# EasyEDA Pro project 24-Dart-Controller.eprj (continued)
## Library data of the parts (continued)
R10 R12 = 0402WGF5101TCE: 电阻类型:厚膜电阻;阻值:5.1kΩ;精度:±1%;功率:62.5mW;最大工作电压:50V;温度系数:±100ppm/℃;; LCSC Part Name: 5.1kΩ ±1% 62.5mW 厚膜电阻; Supplier Part: C25905; Manufacturer: UNI-ROYAL(厚声); Supplier Footprint: 0402; JLCPCB Part Class: 基础库; Datasheet: https://atta.szlcsc.com/upload/public/pdf/source/20200306/C422600_1E6D84923E4A46A82E41ADD87F860B5C.pdf; Supplier: LCSC; Type: 厚膜电阻; Tolerance: ±1%; Power(Watts): 62.5mW; Overload Voltage (Max): 50V; Temperature Coefficient: ±100ppm/℃; Operating Temperature Range: -55℃~+155℃
R13 = 0402WGF1003TCE: 电阻类型:厚膜电阻;阻值:100kΩ;精度:±1%;功率:62.5mW;最大工作电压:50V;温度系数:±100ppm/℃;; LCSC Part Name: 100kΩ ±1% 62.5mW 厚膜电阻; Supplier Part: C25741; Manufacturer: UNI-ROYAL(厚声); Supplier Footprint: 0402; JLCPCB Part Class: Basic Part; Datasheet: https://atta.szlcsc.com/upload/public/pdf/source/20200306/C422600_1E6D84923E4A46A82E41ADD87F860B5C.pdf; Supplier: LCSC; Type: 厚膜电阻; Tolerance: ±1%; Power(Watts): 62.5mW; Overload Voltage (Max): 50V; Temperature Coefficient: ±100ppm/℃; Operating Temperature Range: -55℃~+155℃
R14 = 0402WGF2200TCE: 电阻类型:厚膜电阻;阻值:220Ω;精度:±1%;功率:62.5mW;最大工作电压:50V;温度系数:±100ppm/℃;; LCSC Part Name: 220Ω ±1% 62.5mW 厚膜电阻; Supplier Part: C25091; Manufacturer: UNI-ROYAL(厚声); Supplier Footprint: 0402; JLCPCB Part Class: Basic Part; Datasheet: https://atta.szlcsc.com/upload/public/pdf/source/20200306/C422600_1E6D84923E4A46A82E41ADD87F860B5C.pdf; Supplier: LCSC; Type: 厚膜电阻; Tolerance: ±1%; Power(Watts): 62.5mW; Overload Voltage (Max): 50V; Temperature Coefficient: ±100ppm/℃; Operating Temperature Range: -55℃~+155℃
R15 = 0402WGF0000TCE: 电阻类型:厚膜电阻;阻值:0Ω;精度:±1%;功率:62.5mW;最大工作电压:50V;温度系数:±800ppm/℃;; LCSC Part Name: 0Ω ±1% 62.5mW 厚膜电阻; Supplier Part: C17168; Manufacturer: UNI-ROYAL(厚声); Supplier Footprint: 0402; JLCPCB Part Class: 基础库; Datasheet: https://atta.szlcsc.com/upload/public/pdf/source/20200306/C422600_1E6D84923E4A46A82E41ADD87F860B5C.pdf; Supplier: LCSC; Type: 厚膜电阻; Tolerance: ±1%; Power(Watts): 62.5mW; Overload Voltage (Max): 50V; Temperature Coefficient: ±800ppm/℃; Operating Temperature Range: -55℃~+155℃
R16 = 0603WAF200KT5E: 电阻类型:厚膜电阻;阻值:2Ω;精度:±1%;功率:100mW;最大工作电压:75V;温度系数:±200ppm/℃;; LCSC Part Name: 2Ω ±1% 100mW 厚膜电阻; Supplier Part: C22977; Manufacturer: UNI-ROYAL(厚声); Supplier Footprint: 0603; JLCPCB Part Class: 基础库; Datasheet: https://atta.szlcsc.com/upload/public/pdf/source/20200306/C422600_1E6D84923E4A46A82E41ADD87F860B5C.pdf; Supplier: LCSC; Type: 厚膜电阻; Tolerance: ±1%; Power(Watts): 100mW; Overload Voltage (Max): 75V; Temperature Coefficient: ±200ppm/℃; Operating Temperature Range: -55℃~+155℃
R17 R18 = 0603WAF100KT5E: 电阻类型:厚膜电阻;阻值:1Ω;精度:±1%;功率:100mW;最大工作电压:75V;温度系数:±400ppm/℃;; LCSC Part Name: 1Ω ±1% 100mW 厚膜电阻; Supplier Part: C22936; Manufacturer: UNI-ROYAL(厚声); Supplier Footprint: 0603; JLCPCB Part Class: Basic Part; Datasheet: https://atta.szlcsc.com/upload/public/pdf/source/20200306/C422600_1E6D84923E4A46A82E41ADD87F860B5C.pdf; Supplier: LCSC; Type: 厚膜电阻; Tolerance: ±1%; Power(Watts): 100mW; Overload Voltage (Max): 75V; Temperature Coefficient: ±400ppm/℃; Operating Temperature Range: -55℃~+155℃
R19 = 0402WGF2002TCE: 电阻类型:厚膜电阻;阻值:20kΩ;精度:±1%;功率:62.5mW;最大工作电压:50V;温度系数:±100ppm/℃;; LCSC Part Name: 20kΩ ±1% 62.5mW 厚膜电阻; Supplier Part: C25765; Manufacturer: UNI-ROYAL(厚声); Supplier Footprint: 0402; JLCPCB Part Class: 基础库; Datasheet: https://atta.szlcsc.com/upload/public/pdf/source/20200306/C422600_1E6D84923E4A46A82E41ADD87F860B5C.pdf; Supplier: LCSC; Type: 厚膜电阻; Tolerance: ±1%; Power(Watts): 62.5mW; Overload Voltage (Max): 50V; Temperature Coefficient: ±100ppm/℃; Operating Temperature Range: -55℃~+155℃
R20 = 0402WGF3302TCE: 电阻类型:厚膜电阻;阻值:33kΩ;精度:±1%;功率:62.5mW;最大工作电压:50V;温度系数:±100ppm/℃;; LCSC Part Name: 33kΩ ±1% 62.5mW 厚膜电阻; Supplier Part: C25779; Manufacturer: UNI-ROYAL(厚声); Supplier Footprint: 0402; JLCPCB Part Class: 基础库; Datasheet: https://atta.szlcsc.com/upload/public/pdf/source/20200306/C422600_1E6D84923E4A46A82E41ADD87F860B5C.pdf; Supplier: LCSC; Type: 厚膜电阻; Tolerance: ±1%; Power(Watts): 62.5mW; Overload Voltage (Max): 50V; Temperature Coefficient: ±100ppm/℃; Operating Temperature Range: -55℃~+155℃
R21 = 0603WAF2402T5E: 电阻类型:厚膜电阻;阻值:24kΩ;精度:±1%;功率:100mW;最大工作电压:75V;温度系数:±100ppm/℃;; LCSC Part Name: 24kΩ ±1% 100mW 厚膜电阻; Supplier Part: C23352; Manufacturer: UNI-ROYAL(厚声); Supplier Footprint: 0603; JLCPCB Part Class: 基础库; Datasheet: https://atta.szlcsc.com/upload/public/pdf/source/20200306/C422600_1E6D84923E4A46A82E41ADD87F860B5C.pdf; Supplier: LCSC; Type: 厚膜电阻; Tolerance: ±1%; Power(Watts): 100mW; Overload Voltage (Max): 75V; Temperature Coefficient: ±100ppm/℃; Operating Temperature Range: -55℃~+155℃
R22 = RC0402FR-0710KL: 电阻类型:厚膜电阻;阻值:10kΩ;精度:±1%;功率:62.5mW;最大工作电压:50V;温度系数:±100ppm/℃;; LCSC Part Name: 厚膜电阻 10kΩ ±1% 62.5mW; Supplier Part: C60490; Manufacturer: YAGEO(国巨); Supplier Footprint: 0402; JLCPCB Part Class: 扩展库; Datasheet: https://atta.szlcsc.com/upload/public/pdf/source/20170925/C131467_1506321478108990263.pdf; Supplier: LCSC; Type: 厚膜电阻; Tolerance: ±1%; Power(Watts): 62.5mW; Overload Voltage (Max): 50V; Temperature Coefficient: ±100ppm/℃; Operating Temperature Range: -55℃~+155℃
RX TX = Test-Point: Test Point 测试点; Check: false
SW1 SW2 = TS24CA: 电路结构:单刀单掷;按钮形状:矩形按钮;安装方式:卧贴;开关长度:4.55mm;开关宽度:1.8mm;开关高度:3.5mm;触点电流:50mA;额定电压(DC):12V;带灯:-;机械寿命:-;; LCSC Part Name: 4.55*1.8*3.5mm 卧贴 轻触开关; Supplier Part: C393942; Manufacturer: SHOU HAN(首韩); Supplier Footprint: SMD; JLCPCB Part Class: 扩展库; Datasheet: https://atta.szlcsc.com/upload/public/pdf/source/20190521/C393942_591A9E318887EFA4274D34029981AD99.pdf; Supplier: LCSC; Circuit: 单刀单掷; Actuator Style: 矩形按钮; Mounting Style: 卧贴; Switch Length: 4.55mm; Switch Width: 1.8mm; Switch Height: 3.5mm; Contact Current: 50mA; Voltage Rating (DC): 12V
U1 = ESP32-C3-MINI-1: 核心处理器:ESP32-C3芯片;频率:2.402GHz;天线形式:板载PCB天线;发射功率:-98dBm;接收灵敏度:-89dBm;; LCSC Part Name: 乐鑫ESP32 WiFi模块; Supplier Part: C5290152; Manufacturer: RF Crazy(智汉); JLCPCB Part Class: 扩展库; Datasheet: https://atta.szlcsc.com/upload/public/pdf/source/20230407/37C637B0DDC12E28939EC2C137730224.pdf; Supplier: LCSC; Core Processor: ESP32-C3芯片; Support Interface: UART; Antenna Type: 板载PCB天线; Output Power: -98dBm; Operating Voltage: 3V~3.6V; Receive  Current: 82mA; Send  Current: 350mA; Sensitivity: -89dBm; Operating Temperature: -40℃~+81℃
U3 = NU1680: Supplier Part: C9900015597; Supplier Footprint: QFN-16; JLCPCB Part Class: 扩展库; Datasheet: https://atta.szlcsc.comnull; Supplier: LCSC
U4 = IP5306-I2C: 2.1A 充电 2.4 A 放电高集成度移动电源 SOC; Supplier Part: C488349; Manufacturer: INJOINIC(英集芯); Supplier Footprint: ESOP-8; JLCPCB Part Class: 扩展库; Datasheet: https://atta.szlcsc.com/upload/public/pdf/source/20231017/AB6A25E64E1038420E9A7039637542A8.pdf; Supplier: LCSC
USB1 = MicroXNJ: 连接器类型:Micro-B;标准:USB 2.0;公母:母;端口数量:1;触点数量:5P;安装方式:卧贴;额定电流 - 电源:1A;工作温度范围:-20℃~+85℃;; LCSC Part Name: Micro-B 母 卧贴; Supplier Part: C404969; Manufacturer: SHOU HAN(首韩); Supplier Footprint: SMD; JLCPCB Part Class: 扩展库; Datasheet: https://atta.szlcsc.com/upload/public/pdf/source/20220415/2494EDFF499AF6F852F7C820374B6AF3.pdf; Supplier: LCSC; Connector Type: Micro-B; Standard: USB 2.0; Gender: 母; Number of Ports: 1; Number of Contacts: 5P; Mounting Style: 卧贴; Current Rating - Power (Max): 1A; Operating Temperature Range: -20℃~+85℃

## Nets
GND: C1.2 C2.1 C3.1 C4.1 C5.1 C6.1 C7.1 C8.1 C9.1 C10.2 C11.2 C18.1 C19.1 C20.2 C21.1 C22.1 C23.1 C24.1 C25.1 C26.1 C27.2 CN1.2 CN1.3 CN1.4 D2.2(A) LDO1.2(VSS) R6.1 R7.1 R11.2 R13.1 R15.1 R20.1 R22.2 SW1.1 SW1.2 SW1.4 SW2.1 SW2.2 SW2.4 U1.1(GND) U1.2(GND) U1.11(GND) U1.14(GND) U1.36(GND) U1.37(GND) U1.38(GND) U1.39(GND) U1.40(GND) U1.41(GND) U1.42(GND) U1.43(GND) U1.44(GND) U1.45(GND) U1.46(GND) U1.47(GND) U1.48(GND) U1.49(GND) U1.50(GND) U1.51(GND) U1.52(GND) U1.53(GND) U3.1(GND) U3.4(GND) U3.17(EP) U4.9(EP) USB1.5(GND) USB1.6(SH1) USB1.7(SH2) USB1.8(SH3) USB1.9(SH4)
VBAT: F1.1
VCC_3V3: C2.2 C4.2 C5.2 LDO1.5(VOUT) R1.1 R2.2 R3.2 R5.1 R8.2 R9.2 U1.3(3V3)
VIN_5V: C21.2 F2.2 LED2.2(A) R16.2 U4.1(VIN)
VIN_BAT: C3.2 C7.2 C26.2 D2.1(K) F1.2 L1.1 LDO1.1(VIN) R4.2 R17.2 R18.2 R21.1
VIN_COIL_5V: C10.1 Q1.3(D) R10.2 U3.14(VOUT)
VIN_USB_5V: D1.1(K) Q2.3(D) R12.2
ADC_VBAT: C8.2 R4.1 R6.2 U1.12(IO0)
Coil1: C12.1 C13.1 C15.1
Coil2: C16.1 C17.1 U3.5(AC2)
EN_NU1680: C18.2 Q1.1(G) R12.1 R13.2 U3.11(EN_B)
INT_5306: R19.1 R20.2 U1.16(IO10)
KEY: U1.18(IO4) U4.5(KEY)
RST: C6.2 R2.1 SW1.3 U1.8(EN)
SCL: R8.1 U1.13(IO1) U3.10(SCL/ACR) U4.2(LED1)
SDA: R9.1 U1.6(IO3) U3.9(SDA/OS2) U4.3(LED2)
USB_DN: U1.26(IO18) USB1.2(D-)
USB_DP: U1.27(IO19) USB1.3(D+)
VOUT_5V: C22.2 C23.2 C24.2 CN1.1 U4.8(VOUT)
VRECT: C9.2 C19.2 C20.1 R14.1 U3.6(VRECT) U3.15(VRECT)
$1N4196: LED1.1(K) R3.1 U1.5(IO2)
$1N4379: LED1.2(A) R1.2
$1N5379: C1.1 D1.2(A) USB1.1(VBUS)
$1N7141: C14.1 U3.2(COMM1)
$1N7146: C17.2 U3.3(COMM2)
$1N8006: R14.2 U3.7(SINK)
$1N8544: C12.2 C13.2 C14.2 C15.2 C16.2 U3.16(AC1)
$1N8930: R15.2 U3.8(INT_B/OS1)
$1N9094: C11.1 U3.13(V5V)
$1N12470: F2.1 Q1.2(S) Q2.2(S)
$1N12475: Q2.1(G) R10.1 R11.1
$1N15410: R19.2 U4.4(LED3)
$1N16068: L1.2 U4.7(SW)
$1N16164: C27.1 R17.1 R18.1 U4.6(BAT)
$1N16900: R5.2 U1.22(IO8)
$1N17013: TX.1 U1.31(TXD0)
$1N17053: RX.1 U1.30(RXD0)
$1N17339: SW2.3 U1.23(IO9)
$1N27260: LED2.1(C) R7.2
$1N40035: C25.2 R16.1
$1N46827: LDO1.3(CE) R21.2 R22.1

Not connected (* = marked no-connect by the designer): LDO1 4(NC)*; U1 4(NC)* 7(NC)* 9(NC)* 10(NC)* 15(NC)* 17(NC)* 19(IO5)* 20(IO6)* 21(IO7)* 24(NC)* 25(NC)* 28(NC)* 29(NC)* 32(NC)* 33(NC)* 34(NC)* 35(NC)*; U3 12(TEMP/VBAT)*; USB1 4(ID)*

## Notes on the sheets
sheet 1
- ESP32C3
- LDO & 输电端子
- 16.6*13.2
- 防倒灌
- 1A MAX
- Reset
- 2A跳闸防反接
- Type-B 下载口&有线供电口
- NU1680 无线充电
- Boot
- 功率设置：5W/1.0A
- 5V电源选择
- 高电平关断，默认低电平
- 使用选择电路的时候务必去除0Ohm电阻
- 2A跳闸防短路
- MCU上电后才允许通信
- Optional - 调试使用
- 电池输入&电源选择&保护
- IP5306_IIC

# Board PCB
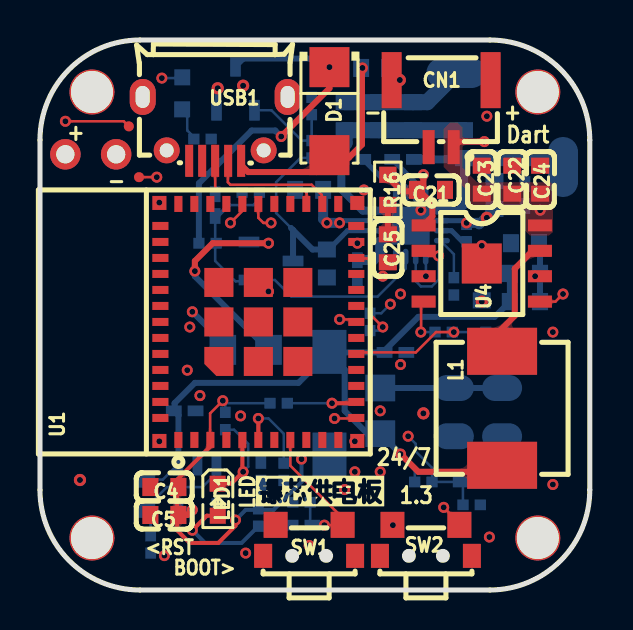
[diagram p3: board, top side]
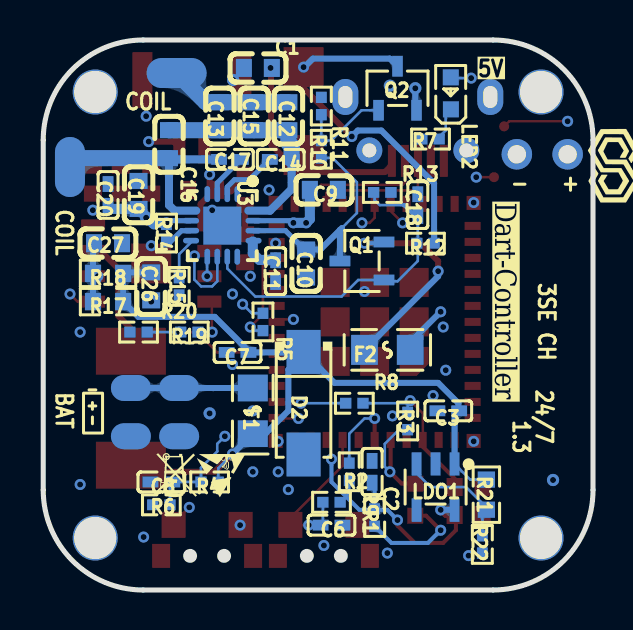
[diagram p4: board, bottom side, seen from below]

Outline 27.5 x 27.5 mm; copper layers: Top Layer, Inner1, Inner2, Bottom Layer. Coordinates in mm from the lower left corner of the outline.
Outline path: 0,22.5 0,5 arc(1.46,1.46) 5,0 22.5,0 arc(26.04,1.46) 27.5,5 27.5,22.5 arc(26.04,26.04) 22.5,27.5 5,27.5 arc(1.46,26.04) 0,22.5
Stack: Top Layer 0.035mm 外层铜厚1oz / Dielectric1 0.2104mm 7628 RC49% 8.6mil / Inner1 0.0152mm 内层铜厚 / Dielectric2 1.065mm 1.1mm H/HOZ 含铜 / Inner2 0.0152mm 内层铜厚 / Dielectric3 0.2104mm 7628 RC49% 8.6mil / Bottom Layer 0.035mm 外层铜厚1oz

## Design rules (mm)
net USB_DN: DP1
net USB_DP: DP1
template: 自定义配置
spacing copperThickness1oz (default): track to track 0.102, other pairs 0.152 to 0.3
spacing copperThickness2oz: track to track 0.203, other pairs 0.152 to 0.3
track width copperThickness1oz (default): min 0.127, default 0.254, max 2.54
track width copperThickness2oz: min 0.203, default 0.254, max 2.54
differential pair differentialPair (default): width min 0.127, default 0.254, max 2.54; gap min 0.152, default 0.152
via viaSize (default): diameter min 0.5, default 0.61, max 10; hole min 0.3, default 0.305, max 6.3
net GND uses power
pour e4161 uses power

## Placement (name value [footprint] x y rotation side)
C1  10uF  [C0603]  16.76 26.1 0 bottom
C2  1uF  [C0402]  11.05 5.91 270 bottom
C3  1uF  [C0402]  7.24 8.96 180 bottom
C4  10uF  [C0603]  6.22 5.15 0 top
C5  100nF  [C0603]  6.22 3.75 0 top
C6  1uF  [C0402]  13.08 3.24 0 bottom
C7  1uF  [C0402]  17.78 11.88 180 bottom
C8  100nF  [C0402]  21.59 5.4 180 bottom
C9  10uF  [C0603]  13.46 20.01 0 bottom
C10  10uF  [C0603]  14.35 16.32 270 bottom
C11  1uF  [C0402]  15.88 15.94 270 bottom
C12  100nF  [C0603]  15.24 23.69 270 bottom
C13  100nF  [C0603]  18.67 23.69 270 bottom
C14  100nF  [C0402]  15.62 21.53 180 bottom
C15  10nF  [C0603]  16.95 23.69 270 bottom
C16  2.2nF  [C0603]  21.21 22.29 90 bottom
C17  100nF  [C0402]  18.16 21.53 180 bottom
C18  100nF  [C0402]  8.76 19.25 270 bottom
C19  10uF  [C0603]  22.73 19.75 270 bottom
C20  100nF  [C0402]  24.26 19.75 90 bottom
C21  10uF  [C0603]  19.56 20.01 180 top
C22  22uF  [C0603]  23.62 20.52 270 top
C23  22uF  [C0603]  22.1 20.52 270 top
C24  22uF  [C0603]  25.02 20.52 270 top
C25  10uF  [C0603]  17.4 17.09 90 top
C26  22uF  [C0603]  22.1 15.18 90 bottom
C27  22uF  [C0603]  24.26 17.34 180 bottom
CN1  WAFER-GH1.25-2PLB  [CONN-TH_2P-P1.25_XUNPU_WAFER-GH1.25-2PLB]  20.07 23.82 180 top
D1  SS34  [SMA_L4.3-W2.6-LS5.2-RD]  14.48 23.94 270 top
D2  SS14  [SMA_L4.2-W2.6-LS5.3-RD]  14.48 9.34 270 bottom
F1  BSMD0805-100-6V  [F0805]  17.02 8.96 270 bottom
F2  BSMD0805-100-6V  [F0805]  10.29 12.01 180 bottom
L1  1uH  [IND-SMD_L7.2-W6.6_GPSR0730]  23.11 9.08 90 top
LDO1  ME6211C33M5G-N  [SOT-23-5_L3.0-W1.7-P0.95-LS2.8-BL]  7.87 5.15 0 bottom
LED1  KT-0603R  [LED0603-RD]  8.89 4.51 270 top
LED2  19-213/Y2C-CQ2R2L/3T(CY)  [LED0603-RD-YELLOW]  7.11 24.83 90 bottom
NOREF  -  [Pad_e11438]  23.11 10.1 0 top
NOREF#2  -  [Pad_e267]  1.27 21.78 0 top
NOREF#3  -  [Pad_e123]  20.83 25.85 0 top
NOREF#4  -  [Pad_e93]  24.9 2.6 0 top
NOREF#5  -  [Pad_e11439]  23.11 7.69 0 top
NOREF#6  -  [Pad_e292]  3.81 21.78 0 top
NOREF#7  -  [Pad_e11436]  20.7 7.69 0 top
NOREF#8  -  [Pad_e89]  2.6 2.6 0 top
NOREF#9  -  [Pad_e92]  24.9 24.9 0 top
NOREF#10  -  [Pad_e91]  2.6 24.9 0 top
NOREF#11  -  [Pad_e11437]  20.7 10.1 0 top
NOREF#12  -  [Pad_e122]  26.16 21.15 90 top
Q1  SI2301CDS-T1-GE3  [SOT-23-3_L3.0-W1.7-P0.95-LS2.9-BR]  11.56 16.45 180 bottom
Q2  SI2301CDS-T1-GE3  [SOT-23-3_L3.0-W1.7-P0.95-LS2.9-BR]  9.78 25.09 270 bottom
R1  1k  [R0402]  10.92 3.62 270 bottom
R2  10k  [R0402]  13.08 4.39 180 bottom
R3  10k  [R0402]  9.27 8.45 90 bottom
R4  100kΩ  [R0402]  19.18 5.4 180 bottom
R5  10k  [R0402]  16.51 13.4 270 bottom
R6  100kΩ  [R0402]  21.59 4.26 180 bottom
R7  1k  [R0402]  8.13 22.55 180 bottom
R8  2.2k  [R0402]  11.94 9.34 180 bottom
R9  2.2k  [R0402]  12.19 5.91 270 bottom
R10  5.1k  [R0402]  13.59 22.04 270 bottom
R11  100k  [R0402]  13.59 24.2 90 bottom
R12  5.1k  [R0402]  8.38 17.34 180 bottom
R13  100k  [R0402]  10.54 19.88 0 bottom
R14  220  [R0402]  21.34 17.85 270 bottom
R15  0Ω  [R0402]  20.7 15.18 90 bottom
R16  2Ω  [R0603]  17.4 20.01 90 top
R17  1Ω  [R0603]  24.26 14.42 180 bottom
R18  1Ω  [R0603]  24.26 15.83 180 bottom
R19  20kΩ  [R0402]  20.19 12.89 180 bottom
R20  33kΩ  [R0402]  22.73 12.89 180 bottom
R21  24kΩ  [R0603]  5.33 4.77 270 bottom
R22  10kΩ  [R0402]  5.54 2.28 270 bottom
RX  -  [Test-Point-0.5mm]  4.95 20.64 0 top
SW1  TS24CA  [SW-SMD_TS24CA]  13.46 2.48 180 top
SW2  TS24CA  [SW-SMD_TS24CA]  19.3 2.48 180 top
TX  -  [Test-Point-0.5mm]  4.44 23.18 0 top
U1  2.402GHz  [WIFIM-SMD_ESP32-C3-MINI-1]  10.92 13.4 90 top
U3  NU1680  [QFN-16_L3.0-W3.0-P0.50-TL-EP1.9]  18.54 18.23 270 bottom
U4  IP5306-I2C  [ESOP-8_L4.9-W3.9-P1.27-LS6.0-BL-EP2.0]  22.1 16.32 270 top
USB1  MicroXNJ  [MICRO-USB-SMD_MICROXNJ]  8.76 23.06 180 top

## Footprints (pads in the part's own frame, mm; a bottom-side part is the same pattern mirrored in y, then rotated)
C0402
  rect 0.79x0.54 smd: 1(-0.545,0) 2(0.545,0)
C0603
  rect 0.8x0.9 smd: 1(-0.7,0) 2(0.7,0)
CONN-TH_2P-P1.25_XUNPU_WAFER-GH1.25-2PLB
  rect 0.6x1.7 smd: 1(-0.625,1.675) 2(0.625,1.675)
  rect 1x2.8 smd: 3(2.475,-1.675) 4(-2.475,-1.675)
ESOP-8_L4.9-W3.9-P1.27-LS6.0-BL-EP2.0
  rect 0.6x1.2 smd: 1(-1.905,-2.909) 2(-0.635,-2.909) 3(0.635,-2.909) 4(1.905,-2.909) 5(1.905,2.909) 6(0.635,2.909) 7(-0.635,2.909) 8(-1.905,2.909)
  rect 2x2 smd: 9(0,0)
F0805
  rect 1.335x1.5 smd: 1(-1.143,0) 2(1.143,0)
IND-SMD_L7.2-W6.6_GPSR0730
  rect 2.35x3.5 smd: 1(-2.85,0) 2(2.85,0)
LED0603-RD
  rect 0.8x0.8 smd: 1(-0.799,-0.004) 2(0.799,0.004)
LED0603-RD-YELLOW
  rect 0.8x0.8 smd: 1(-0.799,-0.004) 2(0.799,0.004)
MICRO-USB-SMD_MICROXNJ
  rect 0.4x1.6 smd: 1(-1.3,1.597) 2(-0.65,1.597) 3(0,1.597) 4(0.65,1.597) 5(1.3,1.597)
  round 1.3 hole 0.7: 6(2.425,1.074) 9(-2.425,1.073)
  oval 1.3x1.8 hole 0.7x1.1: 7(3.625,-1.597) 8(-3.625,-1.597)
Pad_e89
  round 2.25 hole 2.1: 1(0,0)
Pad_e91
  round 2.25 hole 2.1: 1(0,0)
Pad_e92
  round 2.25 hole 2.1: 1(0,0)
Pad_e93
  round 2.25 hole 2.1: 1(0,0)
Pad_e122
  oval 3x1.5 smd far side: 54(0,0)
Pad_e123
  oval 3x1.5 smd far side: 55(0,0)
Pad_e267
  round 1.524 hole 0.914: 56(0,0)
Pad_e292
  round 1.524 hole 0.914: 56(0,0)
Pad_e11436
  oval 2x1.3 smd far side: 54(0,0)
Pad_e11437
  oval 2x1.3 smd far side: 54(0,0)
Pad_e11438
  oval 2x1.3 smd far side: 54(0,0)
Pad_e11439
  oval 2x1.3 smd far side: 54(0,0)
QFN-16_L3.0-W3.0-P0.50-TL-EP1.9
  oval 0.8x0.28 smd: 1(-1.565,0.749) 2(-1.565,0.249) 3(-1.565,-0.251) 4(-1.565,-0.751) 9(1.565,-0.751) 10(1.565,-0.251) 11(1.565,0.249) 12(1.565,0.749)
  oval 0.28x0.8 smd: 5(-0.739,-1.562) 6(-0.238,-1.562) 7(0.261,-1.562) 8(0.761,-1.562) 13(0.761,1.562) 14(0.261,1.562) 15(-0.238,1.562) 16(-0.739,1.562)
  rect 1.9x1.9 smd: 17(0.011,-0.001)
R0402
  rect 0.566x0.54 smd: 1(-0.433,0) 2(0.433,0)
R0603
  rect 0.806x0.864 smd: 1(-0.753,0) 2(0.753,0)
SMA_L4.2-W2.6-LS5.3-RD
  rect 2.2x1.7 smd: 1(-2.566,0) 2(2.566,0)
SMA_L4.3-W2.6-LS5.2-RD
  rect 2x2 smd: 1(-2.2,0) 2(2.2,0)
SOT-23-3_L3.0-W1.7-P0.95-LS2.9-BR
  rect 1.038x0.532 smd: 1(1.101,-0.95) 2(1.101,0.95) 3(-1.101,0)
SOT-23-5_L3.0-W1.7-P0.95-LS2.8-BL
  rect 0.49x1.157 smd: 1(-0.95,-1.153) 2(0,-1.153) 3(0.95,-1.153)
  rect 0.49x1.175 smd: 4(0.95,1.153) 5(-0.95,1.153)
SW-SMD_TS24CA
  rect 0.9x1.2 smd: 1(-2.3,0.775) 2(2.3,0.775)
  rect 1.2x1.3 smd: 3(-1.675,-0.775) 4(1.675,-0.775)
Test-Point-0.5mm
  round 0.5 smd: 1(0,0)
WIFIM-SMD_ESP32-C3-MINI-1
  rect 0.8x0.4 smd: 1(-5.9,4) 2(-5.9,3.2) 3(-5.9,2.4) 4(-5.9,1.6) 5(-5.9,0.8) 6(-5.9,0) 7(-5.9,-0.8) 8(-5.9,-1.6) 9(-5.9,-2.4) 10(-5.9,-3.2) 11(-5.9,-4) 25(5.9,-4) 26(5.9,-3.2) 27(5.9,-2.4) 28(5.9,-1.6) 29(5.9,-0.8) 30(5.9,0) 31(5.9,0.8) 32(5.9,1.6) 33(5.9,2.4) 34(5.9,3.2) 35(5.9,4)
  rect 0.4x0.8 smd: 12(-4.8,-4.9) 13(-4,-4.9) 14(-3.2,-4.9) 15(-2.4,-4.9) 16(-1.6,-4.9) 17(-0.8,-4.9) 18(0,-4.9) 19(0.8,-4.9) 20(1.6,-4.9) 21(2.4,-4.9) 22(3.2,-4.9) 23(4,-4.9) 24(4.8,-4.9) 36(4.8,4.9) 37(4,4.9) 38(3.2,4.9) 39(2.4,4.9) 40(1.6,4.9) 41(0.8,4.9) 42(0,4.9) 43(-0.8,4.9) 44(-1.6,4.9) 45(-2.4,4.9) 46(-3.2,4.9) 47(-4,4.9) 48(-4.8,4.9)
  custom 1.45x1.45 smd: 49(-1.975,1.975)
  rect 1.45x1.45 smd: 49(-1.975,0) 49(-1.975,-1.975) 49(0,1.975) 49(0,0) 49(0,-1.975) 49(1.975,1.975) 49(1.975,0) 49(1.975,-1.975)
  rect 0.7x0.7 smd: 50(5.95,4.95) 51(5.95,-4.95) 52(-5.95,-4.95) 53(-5.95,4.95)

## Nets
As in the schematic, except:
GND: C1.2 C2.1 C3.1 C4.1 C5.1 C6.1 C7.1 C8.1 C9.1 C10.2 C11.2 C18.1 C19.1 C20.2 C21.1 C22.1 C23.1 C24.1 C25.1 C26.1 C27.2 CN1.2 CN1.3 CN1.4 D2.2 LDO1.2 NOREF#4.1 NOREF#5.54 NOREF#6.56 NOREF#7.54 NOREF#8.1 NOREF#9.1 NOREF#10.1 R6.1 R7.1 R11.2 R13.1 R15.1 R20.1 R22.2 SW1.1 SW1.2 SW1.4 SW2.1 SW2.2 SW2.4 U1.1 U1.2 U1.11 U1.14 U1.36 U1.37 U1.38 U1.39 U1.40 U1.41 U1.42 U1.43 U1.44 U1.45 U1.46 U1.47 U1.48 U1.49 U1.50 U1.51 U1.52 U1.53 U3.1 U3.4 U3.17 U4.9 USB1.5 USB1.6 USB1.7 USB1.8 USB1.9
VBAT: F1.1 NOREF.54 NOREF#11.54
COIL1: C12.1 C13.1 C15.1 NOREF#3.55
COIL2: C16.1 C17.1 NOREF#12.54 U3.5
VOUT_5V: C22.2 C23.2 C24.2 CN1.1 NOREF#2.56 U4.8

Pads without a net: LDO1 4; U1 4 7 9 10 15 17 19 20 21 24 25 28 29 32 33 34 35; U3 12; USB1 4

## Via types
v1: diameter 0.61, hole 0.304, Top Layer to Bottom Layer, 6 vias
v2: diameter 0.55, hole 0.3, Top Layer to Bottom Layer, 66 vias
v3: diameter 0.61, hole 0.305, Top Layer to Bottom Layer, 1 via

## Routing (per net, layer and track width the routed paths; a pad name or vN(x,y) marks a point on that pad's centre or on a via; arc(x,y) is an arc through that point)
GND: length 0.1
  Top Layer w0.3: U1.52 15.85,7.43 v2(15.75,7.43)
  vias: v1(2,5.5) v1(10.16,25.21) v1(18,25.5) v1(19.18,8.83) v1(22.1,14.42) v2(5.97,19.37) v2(5.97,7.43) v2(6.22,1.72) v2(7.37,10.99) v2(7.49,13.15) v2(8,9.72) v2(10.03,8.7) v2(10.29,1.85) v2(11.43,14.93) v2(13.46,2.23) v2(15.24,5.02) v2(15.75,5.91) v2(16.2,20) v2(17.02,8.96) v2(17.02,5.91) v2(17.15,15.69) v2(17.65,3.24) v2(18.03,14.8) v2(18.03,11.27) v2(19.05,18.99) v2(22.1,17.21) v2(22.35,23.69) v2(22.48,2.65) v2(25.65,12.89) v2(25.65,5.28)
VBAT: length 6.1
  Bottom Layer w0.3: NOREF.54 NOREF#11.54 18.99,10.1 ; F1.1 18.99,10.1 ; 18.99,10.1 19,10.09
VCC_3V3: length 35.1
  Top Layer w0.127: U1.3 8.51,7.52 8.51,8.83 v2(9.14,9.47)
  Top Layer w0.2: U1.3 8.52,7.18 6.86,5.51 6.86,2.99 7.49,2.35 8.92,2.35 9.78,3.21 v2(9.78,3.5)
  Top Layer w0.3: C5.2 7.37,3.75 v2(7.62,4)
  Inner1 w0.127: v2(17.53,14.29) 12.7,9.47 v2(9.14,9.47)
  Bottom Layer w0.127: 12.33,4.65 12.6,4.39 R2.2 ; 9.27,9.34 R3.2 ; 9.27,9.34 v2(9.14,9.47) ; 9.27,9.34 R8.2 ; R9.2 12.19,4.84 12.36,4.68 ; R5.1 17.07,13.84 v2(17.53,14.29)
  Bottom Layer w0.2: v2(9.78,3.5) 10.29,4 11.68,4 13.08,5.4 v2(13.08,6.55) ; 10.92,5.36 R1.1
  Bottom Layer w0.3: v2(7.62,4) 6.93,4 LDO1.5
VIN_5V: length 36.9
  Top Layer w0.3: U4.1 19.18,18.23 ; 19.18,18.23 18.8,18.23 ; 19.18,18.23 19.63,18.68 19.63,19.3 19.01,19.92 19.01,20.01 ; 19.01,20.01 18.94,19.93 18.11,19.93 17.28,20.76 R16.2 ; 19.01,20.01 19.18,20.17 v2(19.18,20.77)
  Inner1 w0.127: v2(6.1,25.59) 8.51,23.18 12.28,23.18 14.69,20.77
  Inner1 w0.6: v2(19.18,20.77) 14.69,20.77 13.59,19.67 13.59,15.18 12.32,13.91 v2(7.62,13.91)
  Bottom Layer w0.127: v2(6.1,25.59) 7.08,25.59 LED2.2
  Bottom Layer w0.3: F2.2 9.14,12.39 7.62,13.91
VIN_BAT: length 40.9
  Top Layer w0.3: 22.48,6.74 21.65,5.91 18.92,5.91 v2(18.03,6.8)
  Bottom Layer w0.127: R21.1 6.14,5.52 LDO1.1 ; v2(18.03,6.8) 18.74,6.09 R4.2
  Bottom Layer w0.3: LDO1.1 6.92,8.73 C3.2 6.73,9 6.73,9.34 7.75,10.36 12.93,10.36 14.45,11.88 ; 14.45,11.88 14.38,11.88 14.35,11.9 ; 14.45,11.88 14.63,11.88 ; R17.2 23.5,14.17 ; R17.2 23.5,15.69 23.31,15.88 C26.2 ; R17.2 22.74,13.66 18.92,13.66 17.24,11.97 C7.2 14.63,11.88 ; 14.63,11.88 14.5,11.75 15.24,11.02 15.24,8.96 16.38,7.82 F1.2 v2(18.03,6.8)
VIN_COIL_5V: length 11.8
  Bottom Layer w0.127: 12.56,18.1 11.81,18.85 11.81,20.39 13.03,21.61 R10.2
  Bottom Layer w0.254: U3.14 15.38,17.97 14.35,16.94 14.35,16.9
  Bottom Layer w0.3: C10.1 13.63,17.02 12.66,18 ; 12.66,18 12.56,18.1 ; 12.66,18 Q1.3
VIN_USB_5V: length 17.8
  Top Layer w0.3: v2(12.06,22.67) 14.48,25.09 v2(14.48,26.14)
  Bottom Layer w0.3: 14.48,26.1 14.01,26.57 10.16,26.57 Q2.3 ; v2(12.06,22.67) 11.76,22.97 10.59,22.97 7.95,20.34 R12.2
ADC_VBAT: length 10.6
  Top Layer w0.127: U1.12 15.8,8.58 v2(14.73,8.58)
  Inner1 w0.127: v2(14.73,8.58) 15.49,8.58 16.38,7.69 v2(18.41,7.69)
  Bottom Layer w0.127: 20.96,5.4 21.16,5.2 R6.2 ; 20.96,5.4 21.04,5.4 ; 20.96,5.4 R4.1 19.61,6.11 18.8,6.93 18.8,7.31 v2(18.41,7.69)
COIL1: length 6.2
  Bottom Layer w0.8: C12.1 C15.1 C13.1 19.37,24.39 NOREF#3.55
COIL2: length 11.5
  Bottom Layer w0.4: C17.1 21.15,21.53 C16.1 21.21,19.25 20.93,18.97 19.85,18.97
  Bottom Layer w0.8: C16.1 25.72,21.59 NOREF#12.54
EN_NU1680: length 17.5
  Bottom Layer w0.127: R13.2 10.92,19.83 10.92,19.5 10.67,19.25 9.47,19.25 8.8,18.57 8.76,18.57 8.76,16.45 9.78,15.44 10.39,15.44 Q1.1 11.75,15.5 12.57,14.67 16.89,14.67 18.29,16.08 U3.11
  Bottom Layer w0.2: 9.47,19.25 9.44,19.25 8.76,18.57
INT_5306: length 7
  Top Layer w0.127: U1.16 15.9,11.88 18.8,11.88 19.81,12.89 v2(20.7,12.89)
  Bottom Layer w0.127: R20.2 v2(20.7,12.89) R19.1
KEY: length 18.9
  Top Layer w0.127: v2(14.99,13.53) 15.69,13.53 U1.18 ; U4.5 25.78,14.42 v2(26.16,14.8)
  Inner1 w0.127: v2(14.99,13.53) 15.35,13.89 15.35,17.58 15.62,17.85 23.62,17.85 26.16,15.31 v2(26.16,14.8)
RST: length 8
  Top Layer w0.127: v2(14.22,3.24) 15.12,3.24 SW1.3 15.14,3.6 12.52,6.22 U1.8
  Bottom Layer w0.127: R2.1 13.51,3.36 C6.2 v2(14.22,3.24)
SCL: length 17.7
  Top Layer w0.127: v2(19.94,16.7) 19.44,16.7 U4.2
  Top Layer w0.2: v2(14.6,9.34) 15.76,9.34 U1.13
  Inner1 w0.2: v2(19.94,16.7) 19.94,14.67 v2(14.6,9.34)
  Bottom Layer w0.127: v2(19.94,16.7) 19.94,15.52 19.6,15.18 19.05,15.18 18.79,15.44 U3.10 ; 12.37,9.34 v2(14.6,9.34)
SDA: length 17.1
  Top Layer w0.2: U1.6 v2(10.92,8.58)
  Inner1 w0.2: v2(19.3,15.69) 19.3,14.89 17.71,13.29 17.71,12.97 17.35,12.61 16.99,12.61 12.95,8.58 v2(10.92,8.58)
  Bottom Layer w0.127: R9.1 12.19,7.81 11.43,8.58 v2(10.92,8.58) ; U3.9 19.3,16.65 v2(19.3,15.69)
USB_DN: length 6.4
  Top Layer w0.127: 9.4,21.35 9.4,20.39 9.53,20.26 13.59,20.26 14.1,19.75 14.1,19.33 U1.26
USB_DP: length 6.3
  Top Layer w0.127: 8.76,21.2 8.76,20.13 8.92,19.98 13.21,19.98 13.34,19.85 13.34,19.32 U1.27
VOUT_5V: length 31.6
  Top Layer w0.3: CN1.1 20.97,22.42 v2(22.22,22.42)
  Inner2 w0.5: v2(22.22,22.42) 20.19,24.45 14.86,24.45 12.83,26.48 8,26.48 7.49,25.98 7.49,24.58 6.22,23.31 2.79,23.31 NOREF#2.56
  Inner2 w0.6: v2(22.22,22.42) 25.02,19.63 v2(25.02,18.99)
VRECT: length 16.9
  Inner1 w0.254: v2(14.99,18.36) v2(21.34,18.36) 22.1,18.36 v3(22.35,18.61)
  Bottom Layer w0.254: 21.99,18.31 v3(22.35,18.61) ; U3.15 15.1,18.47 v2(14.99,18.36) ; U3.6 21.22,18.47 v2(21.34,18.36)
  Bottom Layer w0.5: C20.1 24.1,19.05 C19.2 21.99,18.31 ; v2(21.34,18.36) 21.89,18.36 21.96,18.28 ; v2(14.99,18.36) v2(14.35,18.36) 14.16,18.55 C9.2
$1N4196: length 6.1
  Top Layer w0.2: LED1.1 8.88,5.32 9.57,5.32 v2(10.16,5.91) 10.12,5.95 U1.5
  Bottom Layer w0.127: R3.1 9.7,8.02 10.41,7.31 10.41,6.16 v2(10.16,5.91)
$1N4379: length 5.5
  Top Layer w0.2: v2(7.62,2.99) 8.34,3.71 LED1.2
  Bottom Layer w0.2: v2(7.62,2.99) 8.25,2.35 10.09,2.35 10.92,3.19
$1N5379: length 10.8
  Top Layer w0.3: USB1.1 10.06,21.25 10.41,20.9 13.84,20.9 14.56,21.62 15.45,21.62 16.1,22.27 16.1,26.08 v2(16.13,26.1)
$1N7141: length 3.1
  Bottom Layer w0.254: U3.2 18.29,20.15 17.93,20.52 17.18,20.52 C14.1
$1N7146: length 2.2
  Bottom Layer w0.254: C17.2 18.79,20.35 U3.3
$1N8006: length 1.5
  Bottom Layer w0.254: 21.34,17.42 21.13,17.42 20.58,17.97 U3.7
$1N8544: length 11.6
  Bottom Layer w0.4: C14.2 15.08,20.04 16.15,18.97 17.24,18.97
  Bottom Layer w0.8: C14.2 15.08,22.2 15.24,22.36 C12.2 C15.2 C13.2 21.21,22.99 21.21,22.99
$1N8930: length 2.1
  Bottom Layer w0.127: 20.08,17.41 20.7,16.79 R15.2
$1N9094: length 1.9
  Bottom Layer w0.5: 15.88,16.61 15.99,16.5 16.69,16.5 17.02,16.83 17.02,17.43
$1N12470: length 21.8
  Top Layer w0.3: v2(7.75,15.94) 7.75,16.45 8.64,17.34 v2(11.43,17.34)
  Inner2 w0.6: v2(7.75,15.94) 7.87,16.07 7.87,20.39 8.89,21.4 v1(8.89,25.09)
  Bottom Layer w0.2: v2(11.43,17.34) 10.52,17.34 Q1.2
  Bottom Layer w0.3: v1(8.89,25.09) 8.89,24.05 Q2.2 ; v2(7.75,15.94) 7.75,15.69 F2.1
$1N12475: length 4.7
  Bottom Layer w0.127: Q2.1 11.58,23.99 13.09,22.47 13.39,22.47 13.59,22.67 R11.1
$1N15410: length 2.3
  Top Layer w0.127: v2(19.05,12.89) 19.06,12.91 19.06,14.29 U4.4
  Bottom Layer w0.127: v2(19.05,12.89) R19.2
$1N16068: length 5.8
  Top Layer w0.3: U4.7 24.64,16.96 23.75,16.07 23.75,13.71 22.48,12.44
$1N16164: length 3.2
  Bottom Layer w0.3: C27.1 25.01,17.29 R18.1 ; v2(24.76,15.69) 25.01,15.44 25.01,14.17
$1N16900: length 5
  Top Layer w0.127: v2(17.15,13.15) 16.51,13.78 16.51,16.45 16.38,16.58 15.85,16.58 U1.22
  Bottom Layer w0.127: v2(17.15,13.15) 16.97,12.97 R5.2
$1N17013: length 16.6
  Top Layer w0.127: v2(9.53,18.36) 10.12,18.95 U1.31 ; v2(1.27,23.44) 4.19,23.44 TX.1
  Inner1 w0.127: v2(1.27,23.44) 6.99,23.44 10.03,20.39 10.03,18.97 9.53,18.46
$1N17053: length 9.5
  Top Layer w0.127: v2(11.56,18.36) 11.18,18.36 10.92,18.61 U1.30 ; v2(5.84,20.64) 5.08,20.64 5.08,20.77
  Inner1 w0.127: v2(11.56,18.36) 11.05,17.85 8.51,17.85 5.84,20.52 v2(5.84,20.64)
$1N17339: length 21.3
  Top Layer w0.127: SW2.3 20.98,3.35 v2(20.19,4.13)
  Inner1 w0.127: v2(20.19,4.13) 18.92,5.4 18.92,8.2 18.54,8.58 18.54,11.62 21.34,14.42 21.34,16.7 20.7,17.34 v2(15.88,17.34)
$1N27260: length 1.7
  Bottom Layer w0.127: R7.2 7.69,22.65 7.37,22.98 7.37,23.65 7.11,23.91 LED2.1
$1N40035: length 1.5
  Top Layer w0.3: R16.1 C25.2
$1N46827: length 6.2
  Bottom Layer w0.127: LDO1.3 8.82,5.84 8.13,5.15 6.35,5.15 5.33,4.13 R21.2 5.54,3.81 R22.1

## Copper pours and planes (outline as drawn; the poured copper is in the pictures)
GND on Top Layer: -0.13,22.63 -0.12,22.96 -0.07,23.41 0.02,23.85 0.15,24.28 0.32,24.69 0.52,25.09 0.76,25.47 1.03,25.83 1.34,26.16 1.67,26.47 2.03,26.74 2.41,26.98 2.81,27.18 3.22,27.35 3.65,27.48 4.09,27.57 4.54,27.62 4.87,27.63 22.37,27.63 22.71,27.62 23.16,27.57 23.59,27.48 24.02,27.35 24.44,27.18 24.84,26.98 25.22,26.74 25.58,26.47 25.91,26.16 26.21,25.83 26.48,25.47 26.72,25.09 26.93,24.69 27.09,24.28 27.22,23.85 27.31,23.41 27.36,22.96 27.37,22.63 27.37,5.13 27.36,4.79 27.31,4.34 27.22,3.91 27.09,3.48 26.93,3.06 26.72,2.66 26.48,2.28 26.21,1.92 25.91,1.59 25.58,1.29 25.22,1.02 24.84,0.78 24.44,0.57 24.02,0.41 23.59,0.28 23.16,0.19 22.71,0.14 22.37,0.13 4.87,0.13 4.54,0.14 4.09,0.19 3.65,0.28 3.22,0.41 2.81,0.57 2.41,0.78 2.03,1.02 1.67,1.29 1.34,1.59 1.03,1.92 0.76,2.28 0.52,2.66 0.32,3.06 0.15,3.48 0.02,3.91 -0.07,4.34 -0.12,4.79 -0.13,5.13
GND on Bottom Layer: 0,22.5 0.01,22.84 0.06,23.28 0.15,23.72 0.28,24.15 0.45,24.57 0.65,24.97 0.89,25.35 1.16,25.7 1.46,26.04 1.8,26.34 2.15,26.61 2.53,26.85 2.93,27.05 3.35,27.22 3.78,27.35 4.22,27.44 4.66,27.49 5,27.5 22.5,27.5 22.84,27.49 23.28,27.44 23.72,27.35 24.15,27.22 24.57,27.05 24.97,26.85 25.35,26.61 25.7,26.34 26.04,26.04 26.34,25.7 26.61,25.35 26.85,24.97 27.05,24.57 27.22,24.15 27.35,23.72 27.44,23.28 27.49,22.84 27.5,22.5 27.5,5 27.49,4.66 27.44,4.22 27.35,3.78 27.22,3.35 27.05,2.93 26.85,2.53 26.61,2.15 26.34,1.8 26.04,1.46 25.7,1.16 25.35,0.89 24.97,0.65 24.57,0.45 24.15,0.28 23.72,0.15 23.28,0.06 22.84,0.01 22.5,0 5,0 4.66,0.01 4.22,0.06 3.78,0.15 3.35,0.28 2.93,0.45 2.53,0.65 2.15,0.89 1.8,1.16 1.46,1.46 1.16,1.8 0.89,2.15 0.65,2.53 0.45,2.93 0.28,3.35 0.15,3.78 0.06,4.22 0.01,4.66 0,5
GND on Inner1: 0,22.5 0.01,22.84 0.06,23.28 0.15,23.72 0.28,24.15 0.45,24.57 0.65,24.97 0.89,25.35 1.16,25.7 1.46,26.04 1.8,26.34 2.15,26.61 2.53,26.85 2.93,27.05 3.35,27.22 3.78,27.35 4.22,27.44 4.66,27.49 5,27.5 22.5,27.5 22.84,27.49 23.28,27.44 23.72,27.35 24.15,27.22 24.57,27.05 24.97,26.85 25.35,26.61 25.7,26.34 26.04,26.04 26.34,25.7 26.61,25.35 26.85,24.97 27.05,24.57 27.22,24.15 27.35,23.72 27.44,23.28 27.49,22.84 27.5,22.5 27.5,5 27.49,4.66 27.44,4.22 27.35,3.78 27.22,3.35 27.05,2.93 26.85,2.53 26.61,2.15 26.34,1.8 26.04,1.46 25.7,1.16 25.35,0.89 24.97,0.65 24.57,0.45 24.15,0.28 23.72,0.15 23.28,0.06 22.84,0.01 22.5,0 5,0 4.66,0.01 4.22,0.06 3.78,0.15 3.35,0.28 2.93,0.45 2.53,0.65 2.15,0.89 1.8,1.16 1.46,1.46 1.16,1.8 0.89,2.15 0.65,2.53 0.45,2.93 0.28,3.35 0.15,3.78 0.06,4.22 0.01,4.66 0,5
GND on Inner2: 0,22.5 0.01,22.84 0.06,23.28 0.15,23.72 0.28,24.15 0.45,24.57 0.65,24.97 0.89,25.35 1.16,25.7 1.46,26.04 1.8,26.34 2.15,26.61 2.53,26.85 2.93,27.05 3.35,27.22 3.78,27.35 4.22,27.44 4.66,27.49 5,27.5 22.5,27.5 22.84,27.49 23.28,27.44 23.72,27.35 24.15,27.22 24.57,27.05 24.97,26.85 25.35,26.61 25.7,26.34 26.04,26.04 26.34,25.7 26.61,25.35 26.85,24.97 27.05,24.57 27.22,24.15 27.35,23.72 27.44,23.28 27.49,22.84 27.5,22.5 27.5,5 27.49,4.66 27.44,4.22 27.35,3.78 27.22,3.35 27.05,2.93 26.85,2.53 26.61,2.15 26.34,1.8 26.04,1.46 25.7,1.16 25.35,0.89 24.97,0.65 24.57,0.45 24.15,0.28 23.72,0.15 23.28,0.06 22.84,0.01 22.5,0 5,0 4.66,0.01 4.22,0.06 3.78,0.15 3.35,0.28 2.93,0.45 2.53,0.65 2.15,0.89 1.8,1.16 1.46,1.46 1.16,1.8 0.89,2.15 0.65,2.53 0.45,2.93 0.28,3.35 0.15,3.78 0.06,4.22 0.01,4.66 0,5
VOUT_5V on Top Layer: 20.19,23.37 25.66,23.37 25.66,17.72 20.19,17.72

Small or netless copper shapes (teardrops, artwork), in the pictures only: 71 on Top Layer, 149 on Bottom Layer, 22 on Inner1, 2 on Inner2

## Text on the board
Bottom Silkscreen Layer: COIL | + | - | 3SE CH | 24/7 | 1.3 | 5V | BAT | Dart-Controller
Top Silkscreen Layer: <RST | BOOT> | LED | 24/7 | 1.3 | + | - | Dart | 镖芯供电板
